# EAGLE design Charger_PCB (EAGLE 7.5.0)

## Sheet 1 of 2
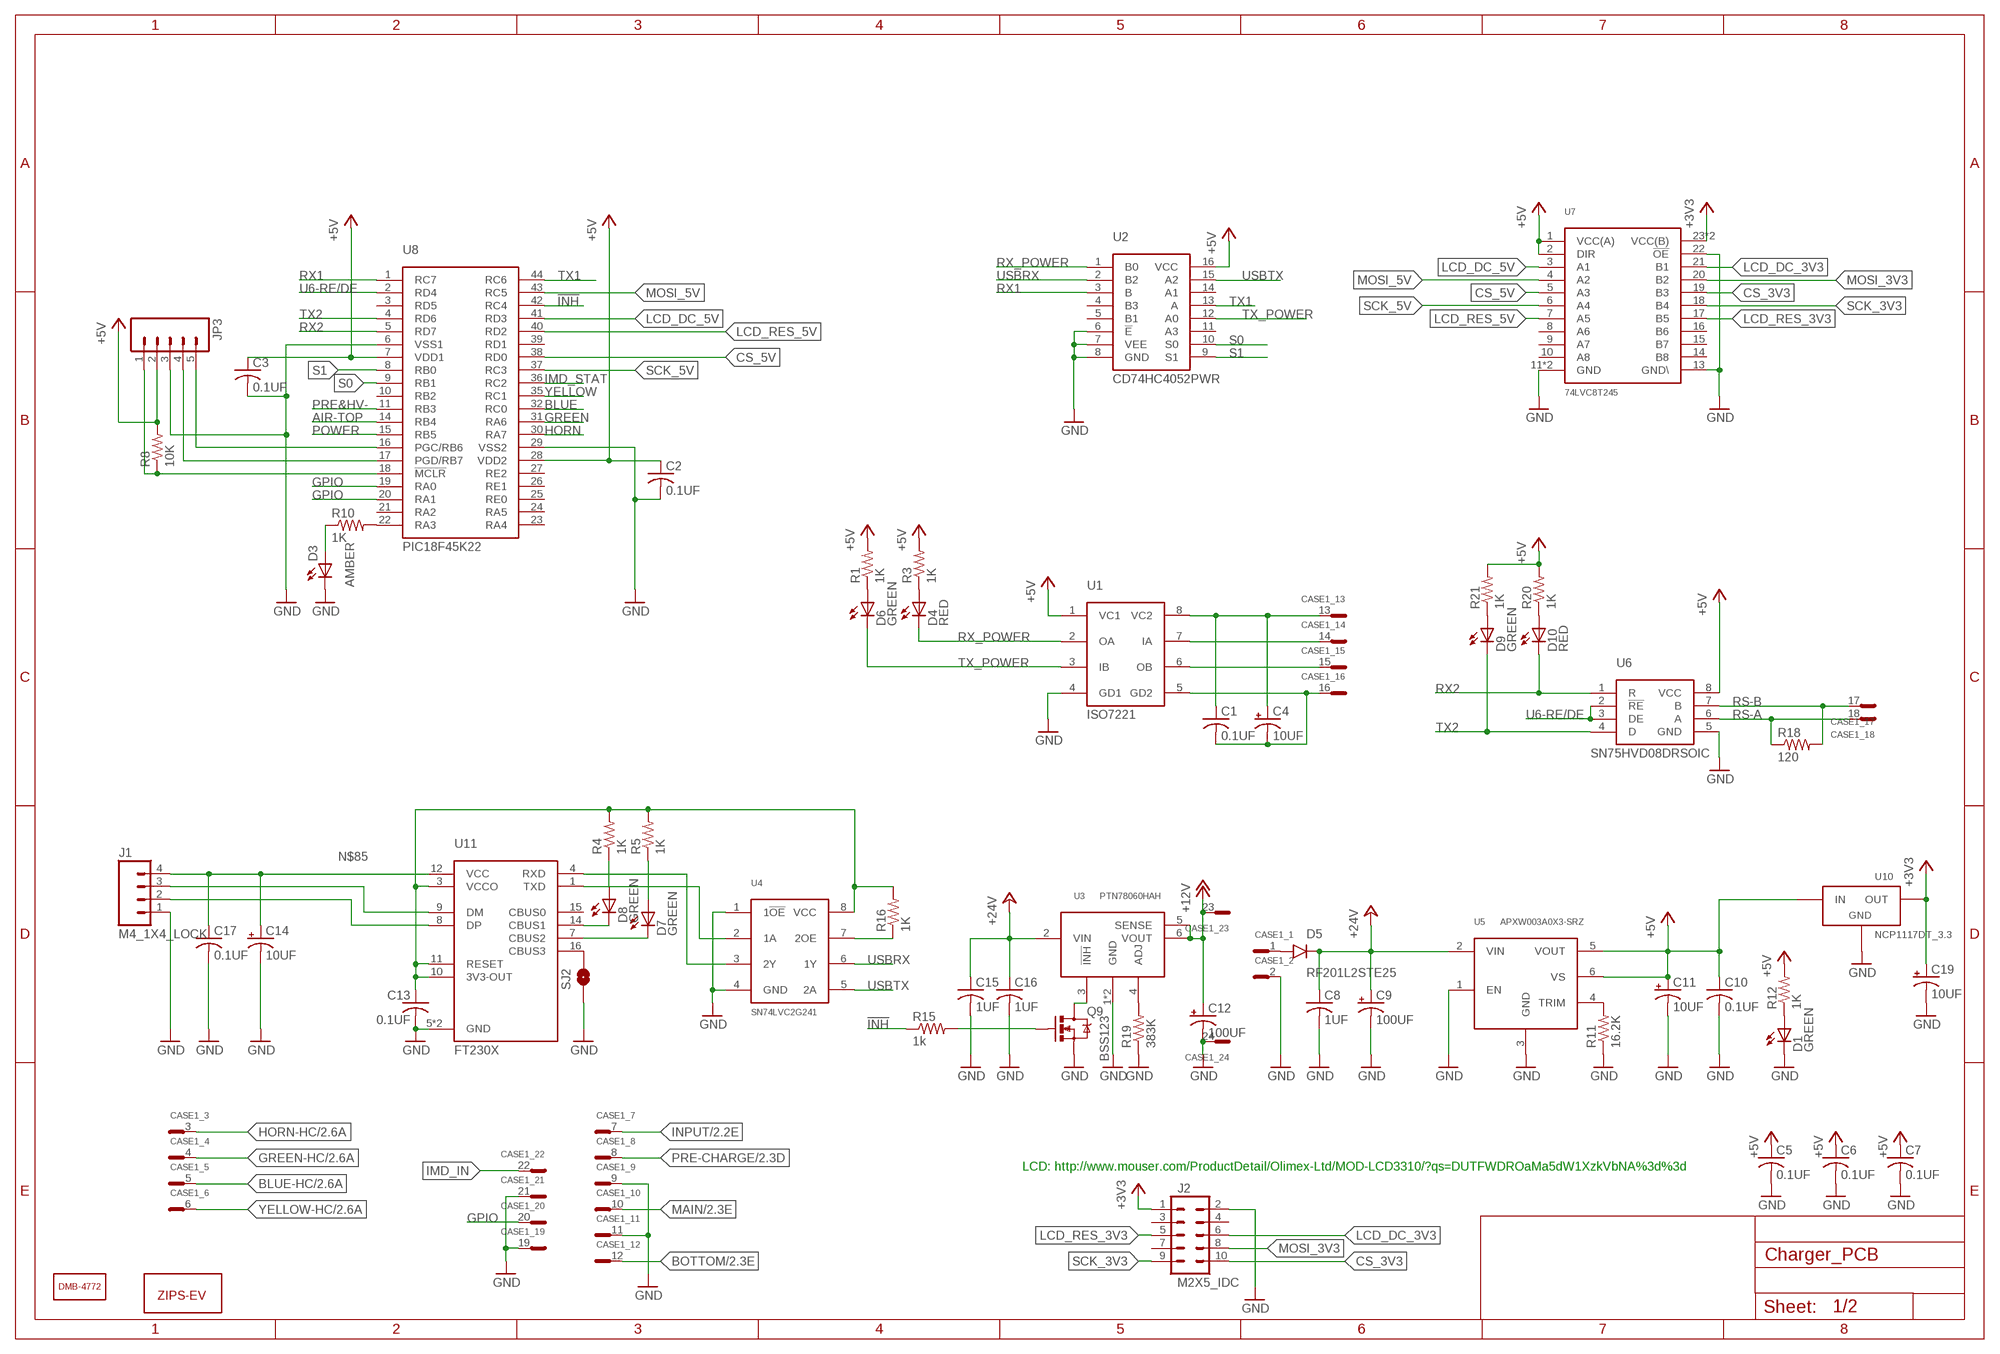
[diagram p0: schematic, sheet 1]

### Parts
C1  0.1UF  CAP_0.1UF_50V_0805  [0805]
C2  0.1UF  CAP_0.1UF_50V_0805  [0805]
C3  0.1UF  CAP_0.1UF_50V_0805  [0805]
C4  10UF  CAP-POL_10UF_16V  [EIA3216-16V]
C5  0.1UF  CAP_0.1UF_50V_0805  [0805]
C6  0.1UF  CAP_0.1UF_50V_0805  [0805]
C7  0.1UF  CAP_0.1UF_50V_0805  [0805]
C8  1UF  CAP_1UF_50V  [1206]
C9  100UF  CAP-POL_100UF_50V_SMD  [PANASONIC-G]
C10  0.1UF  CAP_0.1UF_50V_0805  [0805]
C11  10UF  CAP-POL_10UF_16V  [EIA3216-16V]
C12  100UF  CAP-POL_100UF_50V_SMD  [PANASONIC-G]
C13  0.1UF  CAP_0.1UF_50V_0805  [0805]
C14  10UF  CAP-POL_10UF_16V  [EIA3216-16V]
C15  1UF  CAP_1UF_50V_0805  [0805]
C16  1UF  CAP_1UF_50V_0805  [0805]
C17  0.1UF  CAP_0.1UF_50V_0805  [0805]
C19  10UF  CAP-POL_10UF_16V  [EIA3216-16V]
CASE1  DMB-4772_A  [DMB-4772-A]
D1  GREEN  LED_GREEN  [CHIP_LED0805]
D3  AMBER  LED_AMBER  [CHIP_LED0805]
D4  RED  LED_RED  [CHIP_LED0805]
D5  RF201L2STE25  DIODE_RF201L2STE25  [SMA]
D6  GREEN  LED_GREEN  [CHIP_LED0805]
D7  GREEN  LED_GREEN  [CHIP_LED0805]
D8  GREEN  LED_GREEN  [CHIP_LED0805]
D9  GREEN  LED_GREEN  [CHIP_LED0805]
D10  RED  LED_RED  [CHIP_LED0805]
J1  M4_1X4_LOCK  [MOLEX_1X4]
J2  M2X5_IDC  [3020-10-0100-00]
JP3  M05LOCK_LONGPADS  [1X05_LOCK_LONGPADS]
Q9  BSS123  MOS-N_BSS123  [SOT23]
R1  1K  RES_1K_1%_0805  [0805]
R3  1K  RES_1K_1%_0805  [0805]
R4  1K  RES_1K_1%_0805  [0805]
R5  1K  RES_1K_1%_0805  [0805]
R8  10K  RES_10K_1%_0805  [0805]
R10  1K  RES_1K_1%_0805  [0805]
R11  16.2K  RES_16.2K_1%_0805  [0805]
R12  1K  RES_1K_1%_0805  [0805]
R15  1k  RES_1K_1%_0805  [0805]
R16  1K  RES_1K_1%_0805  [0805]
R18  120  RES_120_1%_0805  [0805]
R19  383K  RES_383K_1%_0805  [0805]
R20  1K  RES_1K_1%_0805  [0805]
R21  1K  RES_1K_1%_0805  [0805]
SJ2  JUMPER-PAD-2-NOYES_SILK  [PAD-JUMPER-2-NO_YES_SILK]
U1  ISO7221  [SO-8]
U2  CD74HC4052PWR  [TSSOP-16]
U3  PTN78060HAH  [PTN78060HAH]
U4  SN74LVC2G241  [VFSOP-8]
U5  APXW003A0X3-SRZ  [APXW003A0X3-SRZ]
U6  SN75HVD08DRSOIC  [SO-8]
U7  74LVC8T245  [TSSOP-24]
U8  PIC18F45K22  [TQFP-44]
U10  NCP1117DT_3.3  [DPAK]
U11  FT230X  [SSOP-16]
U$1  LOGO16-2-L  [2016-2-LOGO-L]

### Nets
3V: C13.1(+) R4.2 R5.2 R16.2 U4.8(VCC) U11.3(VCCO) U11.10(3V3-OUT) U11.11(RESET)
!INH: R15.1 U8.42(RC4)
+3V3: C19.A(+) J2.1 U7.23(VCC(B)) U7.24(VCC(B)) U10.2(OUT)
+5V: C2.1(+) C3.1(+) C5.1(+) C6.1(+) C7.1(+) C10.1(+) C11.A(+) JP3.2 R1.2 R3.2 R8.2 R12.2 R20.2 R21.2 U1.1(VC1) U2.16(VCC) U5.5(VOUT) U5.6(VS) U6.8(VCC) U7.1(VCC(A)) U7.2(DIR) U8.7(VDD1) U8.28(VDD2) U10.3(IN) ; also sheet 2
+12V: C12.+ CASE1.23 U3.5(SENSE) U3.6(VOUT)
+24V: C8.1(+) C9.+ C15.1(+) C16.1(+) D5.C U3.2(VIN) U5.2(VIN) ; also sheet 2
AIR-TOP: U8.14(RB4) ; also sheet 2
BLUE: U8.32(RC0) ; also sheet 2
BLUE-HC: CASE1.5 ; also sheet 2
BOTTOM: CASE1.12 ; also sheet 2
CS_3V3: J2.10 U7.19(B3)
CS_5V: U7.5(A3) U8.38(RD0)
GND: C2.2(-) C3.2(-) C5.2(-) C6.2(-) C7.2(-) C8.2(-) C9.- C10.2(-) C11.C(-) C12.- C13.2(-) C14.C(-) C15.2(-) C16.2(-) C17.2(-) C19.C(-) CASE1.2 CASE1.9 CASE1.11 CASE1.19 CASE1.21 CASE1.24 D1.C D3.C J1.1 J2.2 JP3.3 Q9.2(S) R11.1 R19.1 SJ2.1 U1.4(GD1) U2.6(!E) U2.7(VEE) U2.8(GND) U3.1(GND) U3.7(GND) U4.1(1!OE) U4.4(GND) U5.1(EN) U5.3(GND) U6.5(GND) U7.11(GND) U7.12(GND) U7.13(GND\) U7.22(!OE) U8.6(VSS1) U8.29(VSS2) U10.1(GND) U11.5(GND) U11.13(GND) ; also sheet 2
GPIO: CASE1.20 U8.19(RA0) U8.20(RA1)
GREEN: U8.31(RA6) ; also sheet 2
GREEN-HC: CASE1.4 ; also sheet 2
HORN: U8.30(RA7) ; also sheet 2
HORN-HC: CASE1.3 ; also sheet 2
IMD_IN: CASE1.22 ; also sheet 2
IMD_STAT: U8.36(RC2) ; also sheet 2
INPUT: CASE1.7 ; also sheet 2
LCD_DC_3V3: J2.6 U7.21(B1)
LCD_DC_5V: U7.3(A1) U8.41(RD3)
LCD_RES_3V3: J2.5 U7.17(B5)
LCD_RES_5V: U7.7(A5) U8.40(RD2)
MAIN: CASE1.10 ; also sheet 2
MOSI_3V3: J2.8 U7.20(B2)
MOSI_5V: U7.4(A2) U8.43(RC5)
N$1: D3.A R10.1
N$2: R10.2 U8.22(RA3)
N$3: C1.1(+) C4.A(+) CASE1.13 U1.8(VC2)
N$4: CASE1.14 U1.7(IA)
N$5: CASE1.15 U1.6(OB)
N$6: C1.2(-) C4.C(-) CASE1.16 U1.5(GD2)
N$7: D6.A R1.1
N$8: D4.A R3.1
N$9: D7.A R5.1
N$10: D8.A R4.1
N$12: Q9.3(D) U3.3(!INH)
N$16: R11.2 U5.4(TRIM)
N$17: D1.A R12.1
N$18: R19.2 U3.4(ADJ)
N$19: Q9.1(G) R15.2
N$20: D9.A R21.1
N$22: D10.A R20.1
N$28: SJ2.2 U11.16(CBUS3)
N$29: CASE1.1 D5.A
N$30: U4.2(1A) U11.1(TXD)
N$36: D7.C U11.7(CBUS2)
N$38: D8.C U11.14(CBUS1)
N$39: U4.3(2Y) U11.4(RXD)
N$40: JP3.4 U8.17(PGD/RB7)
N$42: J1.3 U11.9(DM)
N$43: JP3.5 U8.16(PGC/RB6)
N$46: JP3.1 R8.1 U8.18(!MCLR)
N$54: J1.2 U11.8(DP)
N$69: R16.1 U4.7(2OE)
N$85: C14.A(+) C17.1(+) J1.4 U11.12(VCC)
POWER: U8.15(RB5) ; also sheet 2
PRE&HV-: U8.11(RB3) ; also sheet 2
PRE-CHARGE: CASE1.8 ; also sheet 2
RS-A: CASE1.18 R18.1 U6.6(A)
RS-B: CASE1.17 R18.2 U6.7(B)
RX1: U2.3(B) U8.1(RC7)
RX2: D10.C U6.1(R) U8.5(RD7)
RX_POWER: D4.C U1.2(OA) U2.1(B0)
S0: U2.10(S0) U8.9(RB1)
S1: U2.9(S1) U8.8(RB0)
SCK_3V3: J2.9 U7.18(B4)
SCK_5V: U7.6(A4) U8.37(RC3)
TX1: U2.13(A) U8.44(RC6)
TX2: D9.C U6.4(D) U8.4(RD6)
TX_POWER: D6.C U1.3(IB) U2.12(A0)
U6-RE/DE: U6.2(!RE) U6.3(DE) U8.2(RD4)
USBRX: U2.2(B2) U4.6(1Y)
USBTX: U2.15(A2) U4.5(2A)
YELLOW: U8.35(RC1) ; also sheet 2
YELLOW-HC: CASE1.6 ; also sheet 2
Unconnected: J2.3 J2.4 J2.7 U2.4(B3) U2.5(B1) U2.11(A3) U2.14(A1) U7.8(A6) U7.9(A7) U7.10(A8) U7.14(B8) U7.15(B7) U7.16(B6) U8.3(RD5) U8.10(RB2) U8.21(RA2) U8.23(RA4) U8.24(RA5) U8.25(RE0) U8.26(RE1) U8.27(RE2) U8.39(RD1) U11.15(CBUS0)

### Notes on the sheet
- LCD: http://www.mouser.com/ProductDetail/Olimex-Ltd/MOD-LCD3310/?qs=DUTFWDROaMa5dW1XzkVbNA%3d%3d

## Sheet 2 of 2
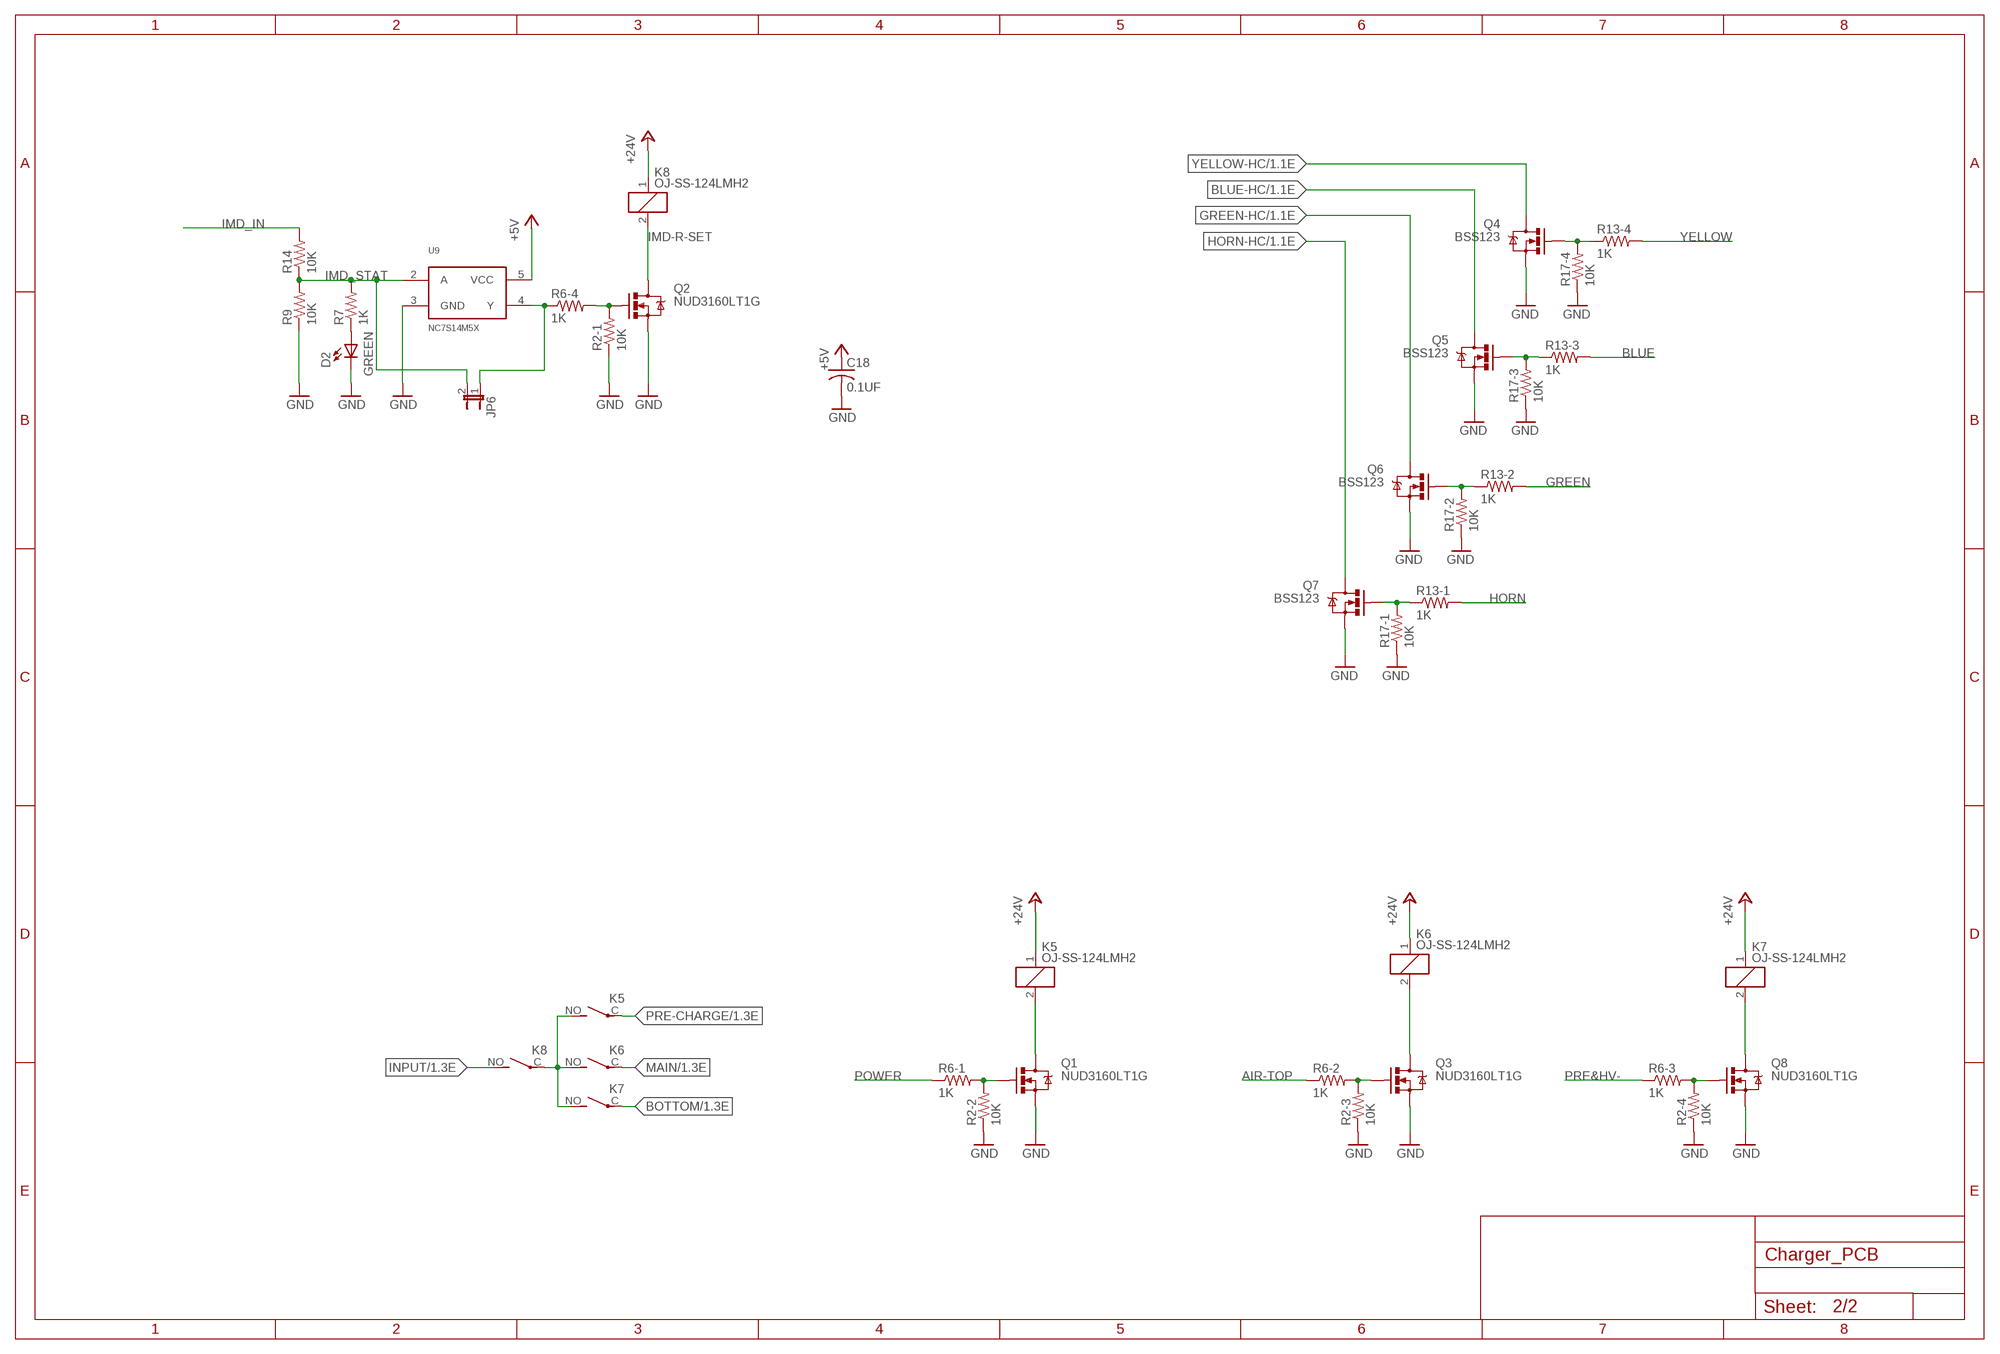
[diagram p1: schematic, sheet 2]

### Parts
C18  0.1UF  CAP_0.1UF_50V_0805  [0805]
D2  GREEN  LED_GREEN  [CHIP_LED0805]
JP6  JUMPER-2SMD-NO  [SJ_2S-NO]
K5  OJ-SS-124LMH2  [OJ-SS-124LMH2]
K6  OJ-SS-124LMH2  [OJ-SS-124LMH2]
K7  OJ-SS-124LMH2  [OJ-SS-124LMH2]
K8  OJ-SS-124LMH2  [OJ-SS-124LMH2]
Q1  NUD3160LT1G  [SOT23]
Q2  NUD3160LT1G  [SOT23]
Q3  NUD3160LT1G  [SOT23]
Q4  BSS123  MOS-N_BSS123  [SOT23]
Q5  BSS123  MOS-N_BSS123  [SOT23]
Q6  BSS123  MOS-N_BSS123  [SOT23]
Q7  BSS123  MOS-N_BSS123  [SOT23]
Q8  NUD3160LT1G  [SOT23]
R2  10K  RN-4_10K  [MNR14]
R6  1K  RN-4_1K  [MNR14]
R7  1K  RES_1K_1%_0805  [0805]
R9  10K  RES_10K_1%_0805  [0805]
R13  1K  RN-4_1K  [MNR14]
R14  10K  RES_10K_1%_0805  [0805]
R17  10K  RN-4_10K  [MNR14]
U9  NC7S14M5X  [SOT23-5]

### Nets
+5V: C18.1(+) U9.5(VCC) ; also sheet 1
+24V: K5.1(+) K6.1(+) K7.1(+) K8.1(+) ; also sheet 1
AIR-TOP: R6.2 ; also sheet 1
BLUE: R13.6 ; also sheet 1
BLUE-HC: Q5.3(D) ; also sheet 1
BOTTOM: K7.C(P) ; also sheet 1
GND: C18.2(-) D2.C Q1.2(S) Q2.2(S) Q3.2(S) Q4.2(S) Q5.2(S) Q6.2(S) Q7.2(S) Q8.2(S) R2.1 R2.2 R2.3 R2.4 R9.1 R17.1 R17.2 R17.3 R17.4 U9.3(GND) ; also sheet 1
GREEN: R13.7 ; also sheet 1
GREEN-HC: Q6.3(D) ; also sheet 1
HORN: R13.8 ; also sheet 1
HORN-HC: Q7.3(D) ; also sheet 1
IMD-R-SET: K8.2(-) Q2.3(D)
IMD-R-SET1: K6.2(-) Q3.3(D)
IMD-R-SET2: K5.2(-) Q1.3(D)
IMD-R-SET3: K7.2(-) Q8.3(D)
IMD_IN: R14.2 ; also sheet 1
IMD_STAT: JP6.2 R7.2 R9.2 R14.1 U9.2(A) ; also sheet 1
INPUT: K8.NO(S) ; also sheet 1
MAIN: K6.C(P) ; also sheet 1
N$11: D2.A R7.1
N$13: K5.NO(S) K6.NO(S) K7.NO(S) K8.C(P)
N$14: Q2.1(G) R2.8 R6.5
N$15: Q8.1(G) R2.5 R6.6
N$21: Q4.1(G) R13.4 R17.5
N$23: Q3.1(G) R2.6 R6.7
N$24: Q1.1(G) R2.7 R6.8
N$25: Q5.1(G) R13.3 R17.6
N$26: Q6.1(G) R13.2 R17.7
N$27: Q7.1(G) R13.1 R17.8
N$31: JP6.1 R6.4 U9.4(Y)
POWER: R6.1 ; also sheet 1
PRE&HV-: R6.3 ; also sheet 1
PRE-CHARGE: K5.C(P) ; also sheet 1
YELLOW: R13.5 ; also sheet 1
YELLOW-HC: Q4.3(D) ; also sheet 1

## Library data of the parts
C1-C3 C5-C7 C10 C13 C17 C18 = FSAE Electric:CAP; PARTNO: CC0805ZRY5V9BB104
C4 C11 C14 C19 = FSAE Electric:CAP-POL; PARTNO: T491A106M016AT
C8 = FSAE Electric:CAP; PARTNO: CC1206ZRY5V9BB105
C9 C12 = FSAE Electric:CAP-POL; PARTNO: EEE-1HA101P
C15 C16 = FSAE Electric:CAP; PARTNO: UMK212F105ZG-T
CASE1 = FSAE Electric:DMB-4772; PARTNO: DMB-4772
D1 D2 D6-D9 = FSAE Electric:LED; PARTNO: LTST-S220GKT
D3 = FSAE Electric:LED; PARTNO: HSMA-C170
D4 D10 = FSAE Electric:LED; PARTNO: LH R974-LP-1
D5 = FSAE Electric:DIODE: Diodes; PARTNO: RF201L2STE25
J1 = FSAE Electric:M4; PARTNO: 0022232041
J2 = FSAE Electric:M2X5; PARTNO: 3020-10-0100-00
JP3 = SparkFun-Connectors:M05: Header 5 Standard 5-pin 0.1" header. Use with straight break away headers (SKU : PRT-00116), right angle break away headers (PRT-00553), swiss pins (PRT-00743), machine pins (PRT-00117), and female headers (PRT-00115). Molex polarized connector foot print use with SKU : PRT-08230 with associated crimp pins and housings.
JP6 = SparkFun-Passives:JUMPER-2: Jumper Basic 0.1" spaced jumper. Use with breakaway headers.
K5-K8 = FSAE Electric:OJ-SS-124LMH2; PARTNO: OJ-SS-124LMH2
Q1-Q3 Q8 = FSAE Electric:NUD3160LT1G; PARTNO: NUD3160LT1G
Q4-Q7 Q9 = FSAE Electric:MOS-N: N-Channel Mosfets; PARTNO: BSS123,215
R1 R3-R5 R7 R10 R12 R15 R16 R20 R21 = FSAE Electric:RES: Resistors; PARTNO: RC0805FR-071KL
R2 R17 = FSAE Electric:RN-4; PARTNO: MNR14ERAPJ103
R6 R13 = FSAE Electric:RN-4; PARTNO: MNR14ERAPJ102
R8 R9 R14 = FSAE Electric:RES: Resistors; PARTNO: RC0805FR-0710KL
R11 = FSAE Electric:RES: Resistors; PARTNO: RC0805FR-0716K2L
R18 = FSAE Electric:RES: Resistors; PARTNO: RC0805FR-07120RL
R19 = FSAE Electric:RES: Resistors; PARTNO: RC0805FR-07383KL
SJ2 = SparkFun-Passives:JUMPER-PAD-2-NO
U1 = FSAE Electric:ISO7221; PARTNO: ISO7221ADR
U2 = FSAE Electric:CD74HC4052PWR; PARTNO: CD74HC4052PWR
U3 = FSAE Electric:PTN78060HAH; PARTNO: PTN78060HAH
U4 = FSAE Electric:SN74LVC2G241; PARTNO: SN74LVC2G241DCUR
U5 = FSAE Electric:APXW003A0X3-SRZ; PARTNO: APXW003A0X3-SRZ
U6 = FSAE Electric:SN75HVD08DR; PARTNO: SN75176BDR
U7 = FSAE Electric:74LVC8T245; PARTNO: 74LVC8T245PW,118
U8 = FSAE Electric:PIC18F45K22; PARTNO: PIC18F45K22T-I/PT
U9 = FSAE Electric:NC7S14M5X; PARTNO: NC7S14M5X
U10 = FSAE Electric:NCP1117DT; PARTNO: NCP1117DT33RKG
U11 = FSAE Electric:FT230X; PARTNO: FT230XS-R
U$1 = Pic:LOGO

## Board
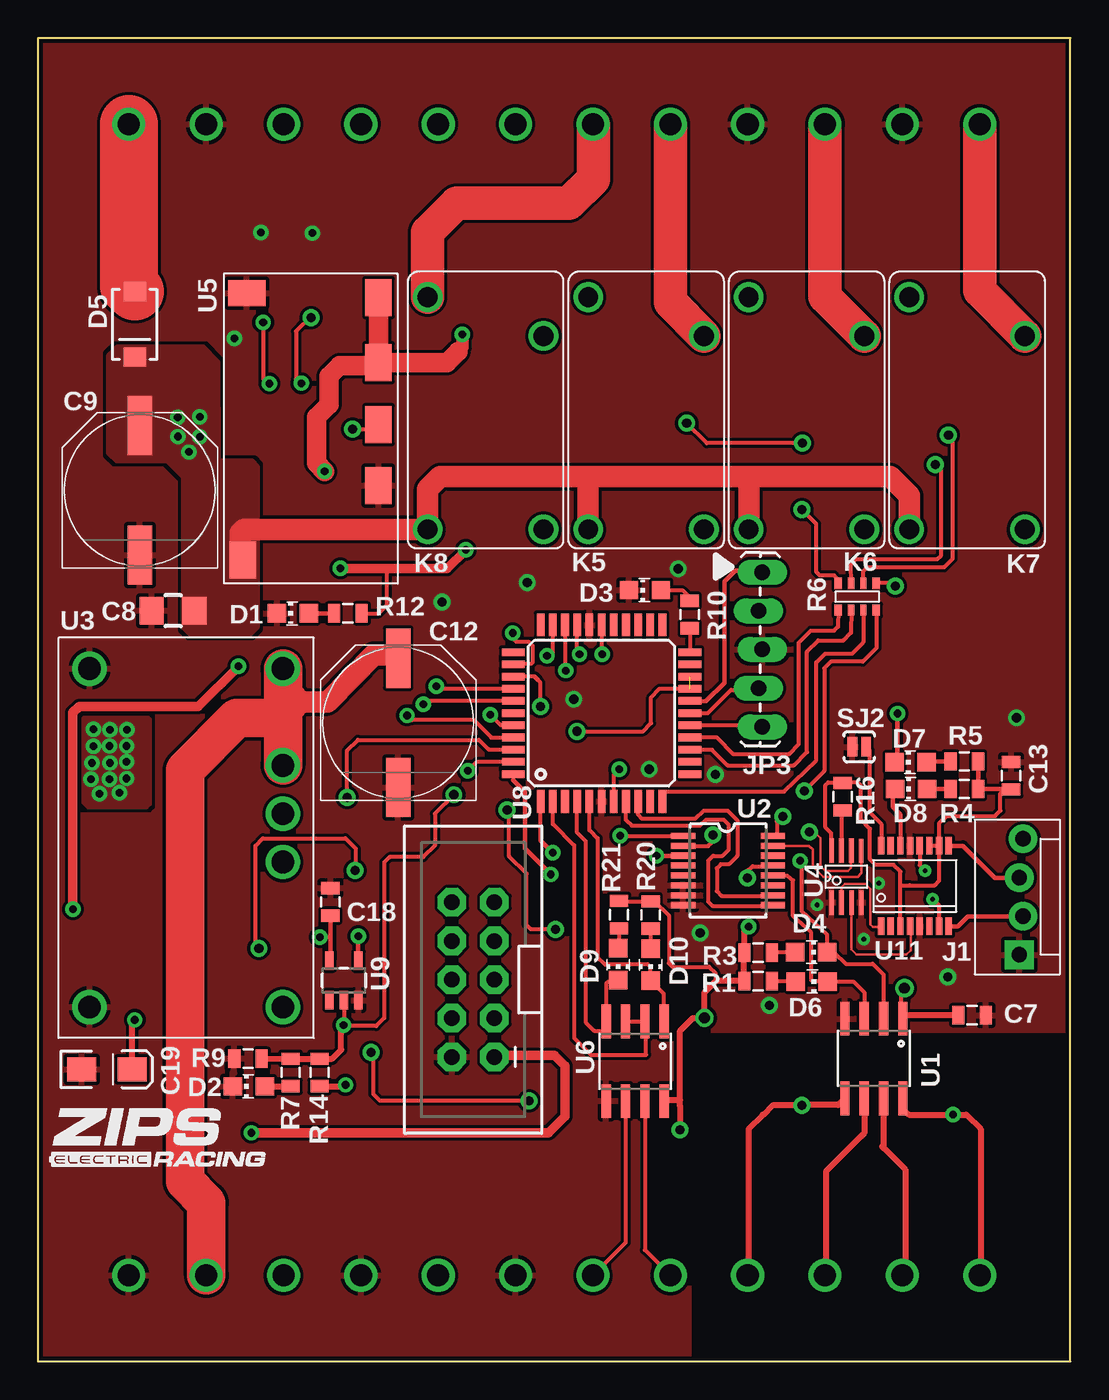
[diagram p2: board, top side]
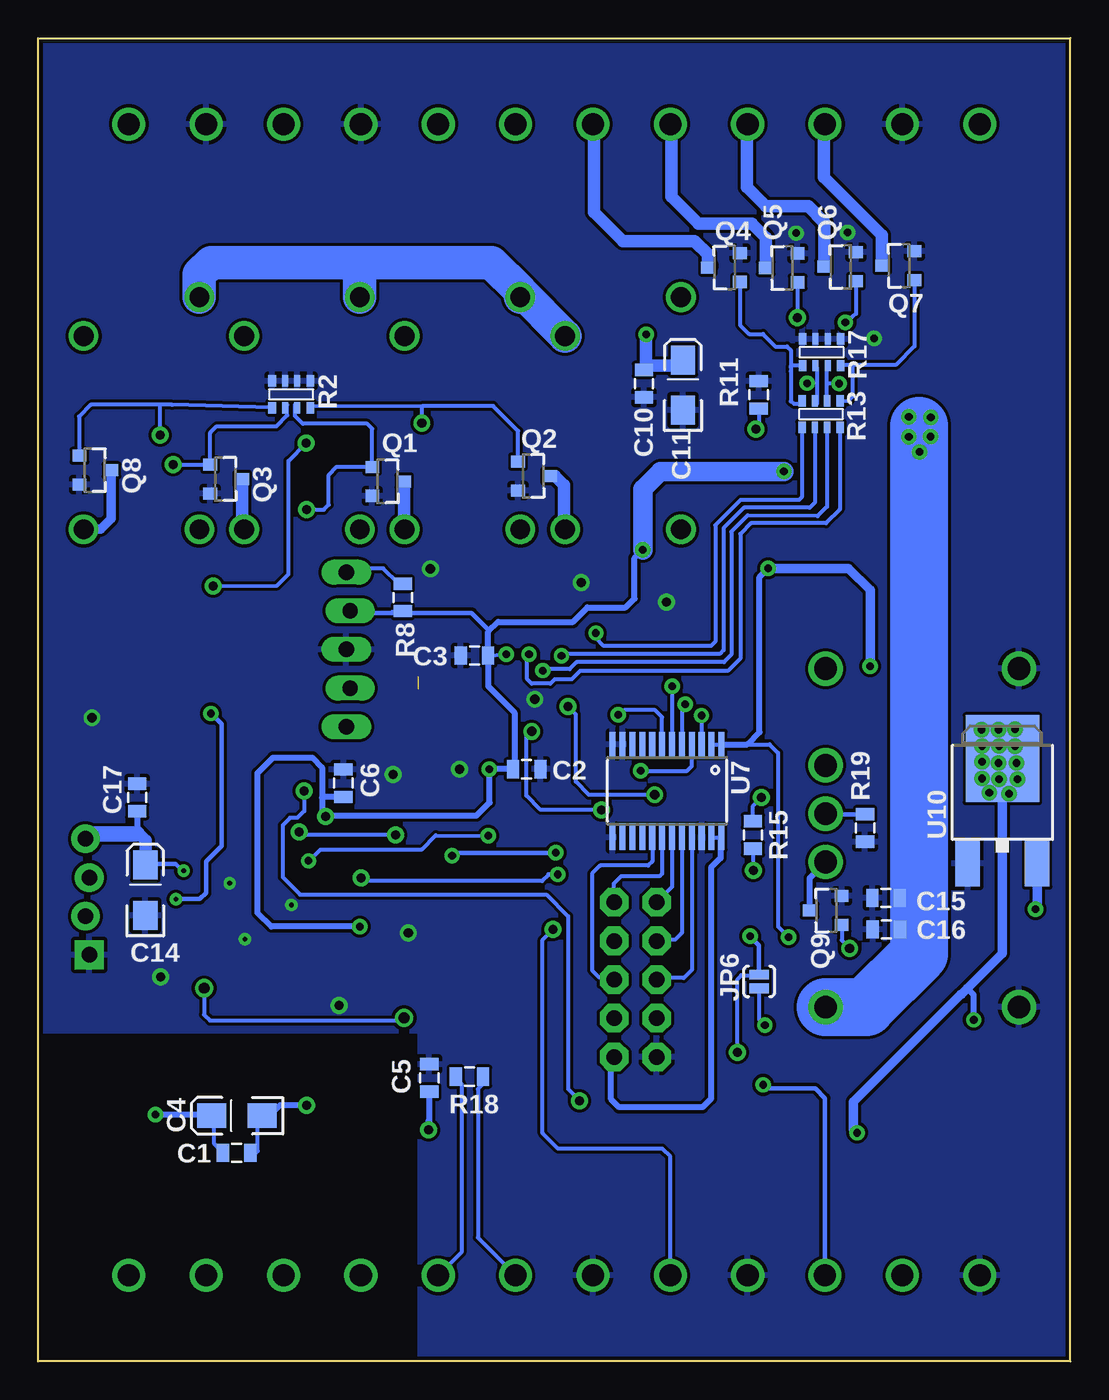
[diagram p3: board, bottom side, seen from below]

Size 67.8 x 86.9 mm. Coordinates in mm from the lower left corner, seen from the top.
Copper layers (1*16): Top 0.035mm / dielectric 1.5mm / Bottom 0.035mm
Design rules "SparkFun *": minimum track width 8mil, minimum drill 18mil, track to track 8mil, track to pad 8mil, pad to pad 8mil, via to via 8mil, smd to smd 8mil, copper to edge 10mil, drill to drill 8mil, minimum pad ring 12mil, minimum via ring 10mil, stop-mask expansion 4mil, vias tented up to drill 25mil, thermal gap 10mil